# EasyEDA Pro project 3SE_24_Power_Rune.eprj, schematic Armour

## Sheets
1 十环灯: Create Date: 2023-11-28; Page Name: 十环灯; Project Name: 3SE_24_Power_Rune; Schematic Name: Armour; Update Date: 2023-12-28; Company: 东南大学3SE战队; Drawed: 程浩; Page Size: A4; Reviewed: 彭延璞，陈申; Version: V1.5
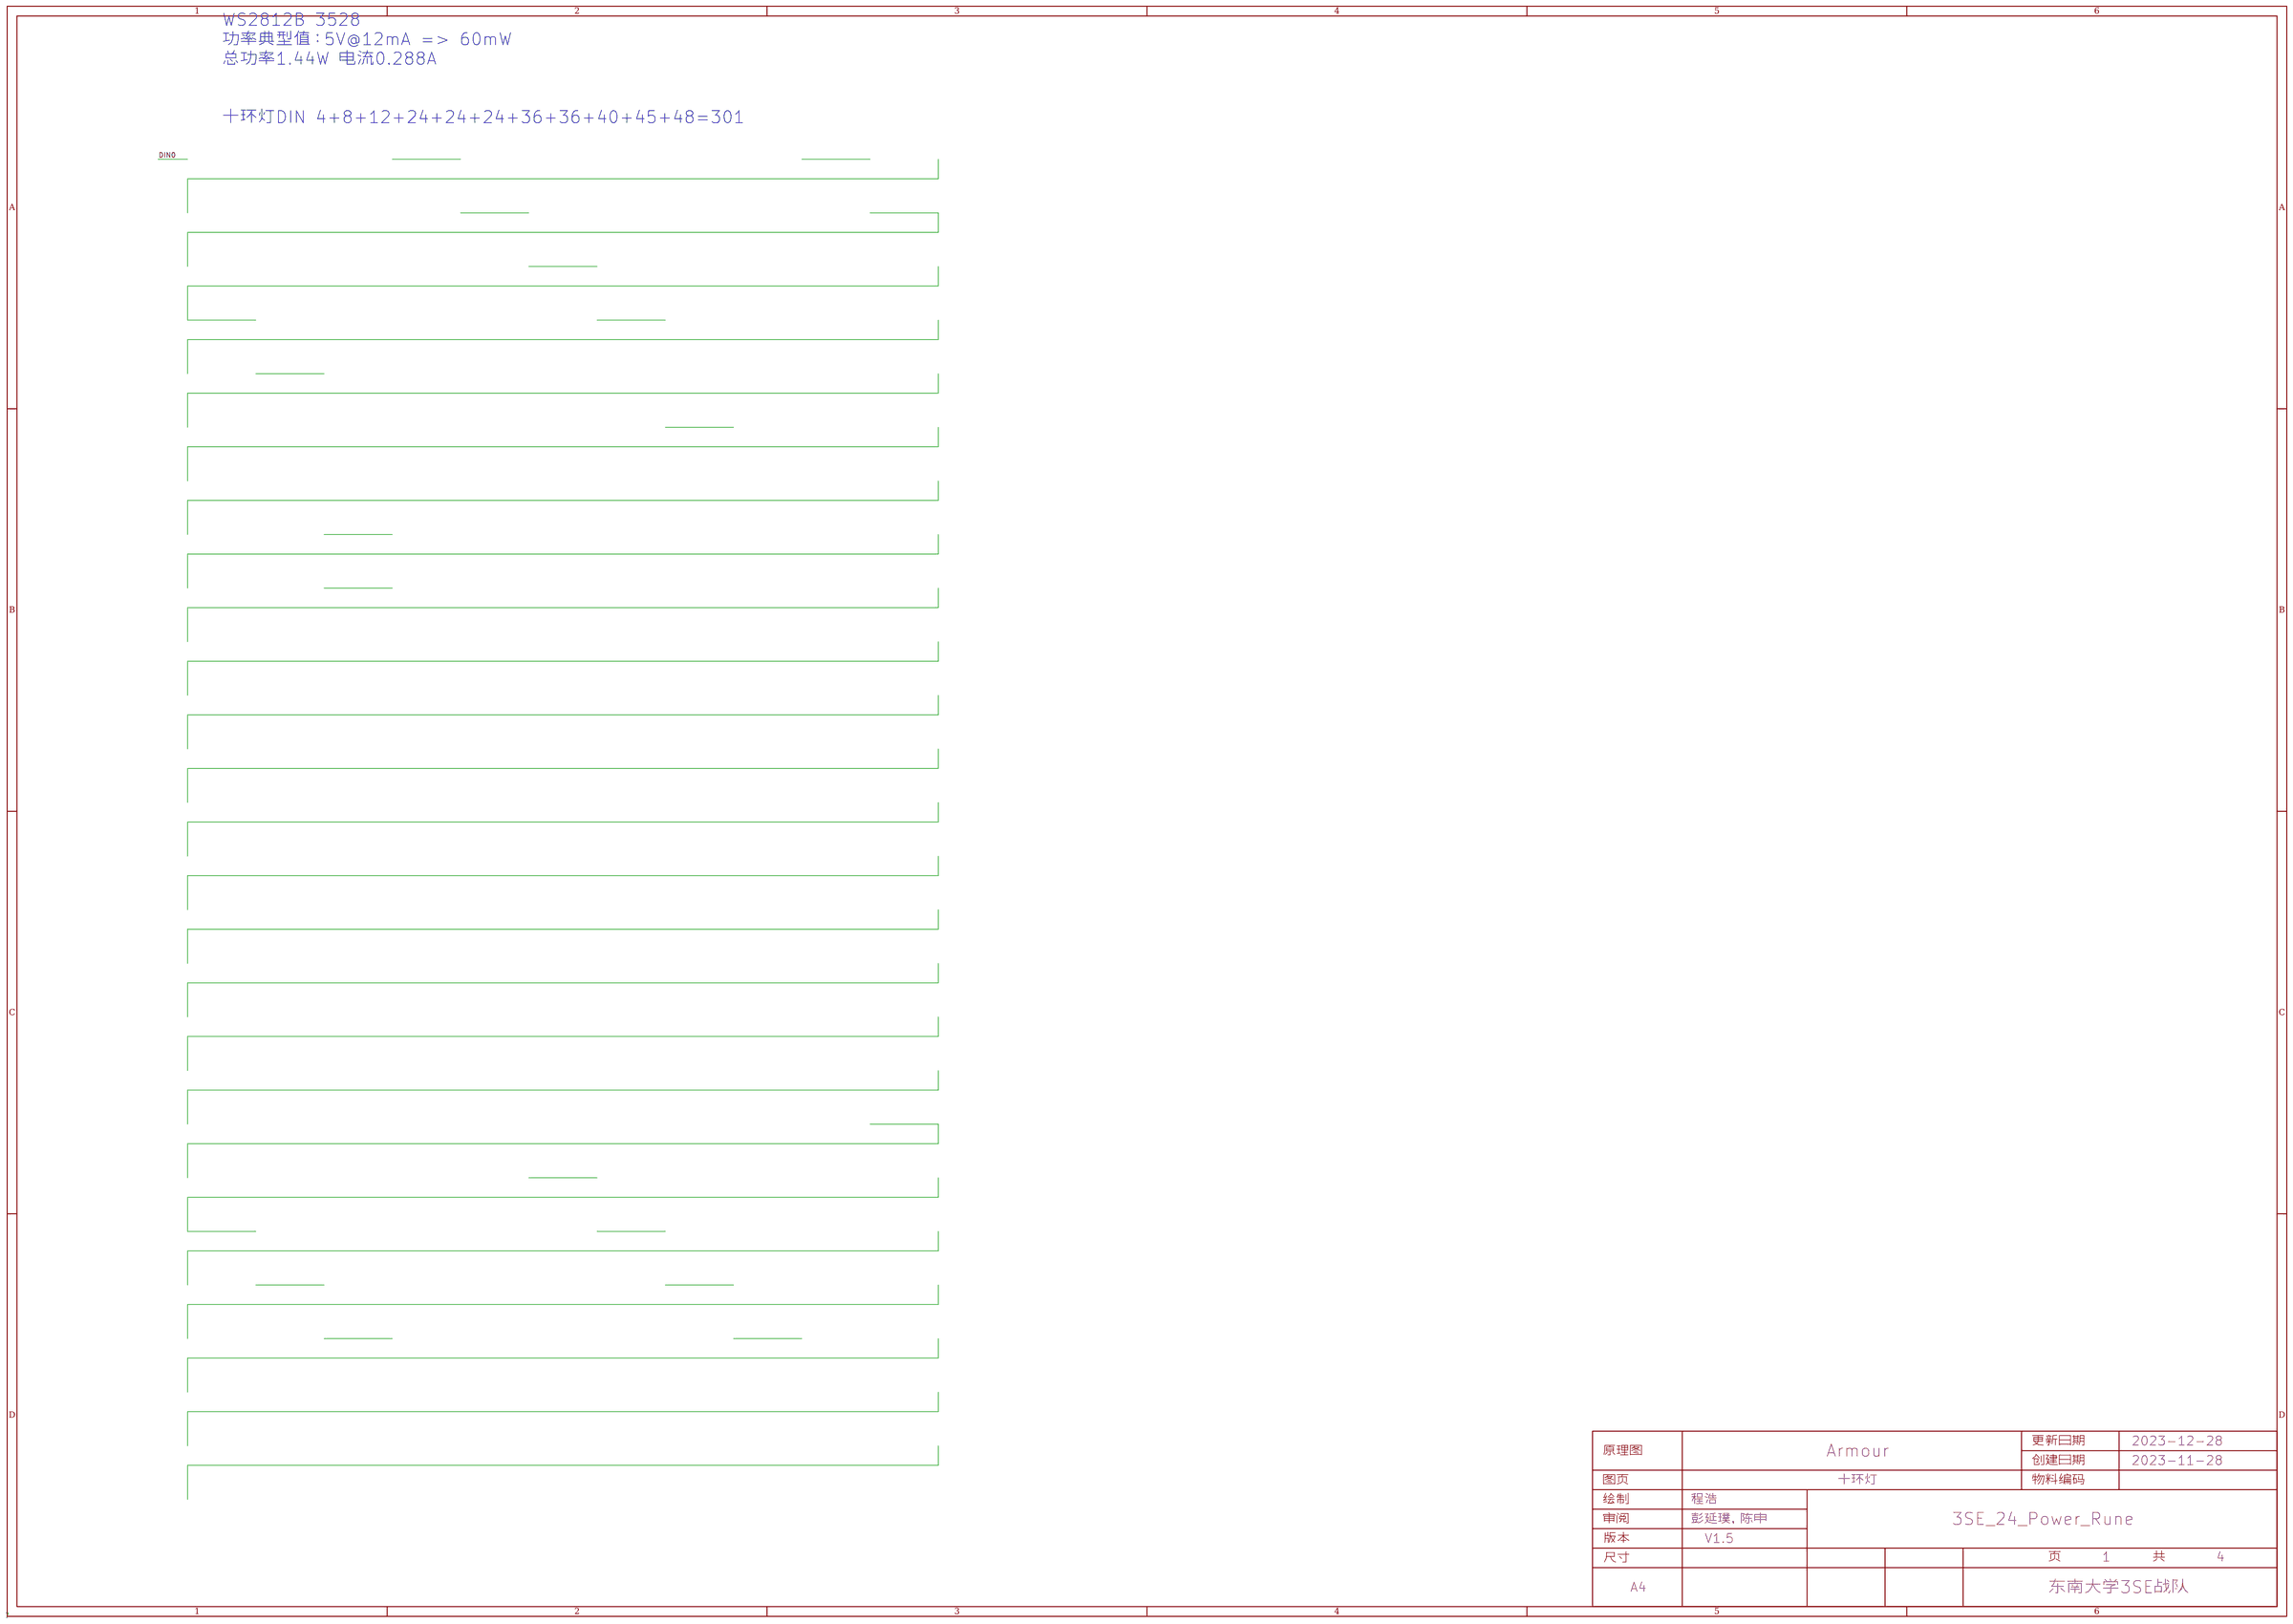
[diagram p2: 十环灯]
2 按键: Create Date: 2023-12-10; Page Name: 按键
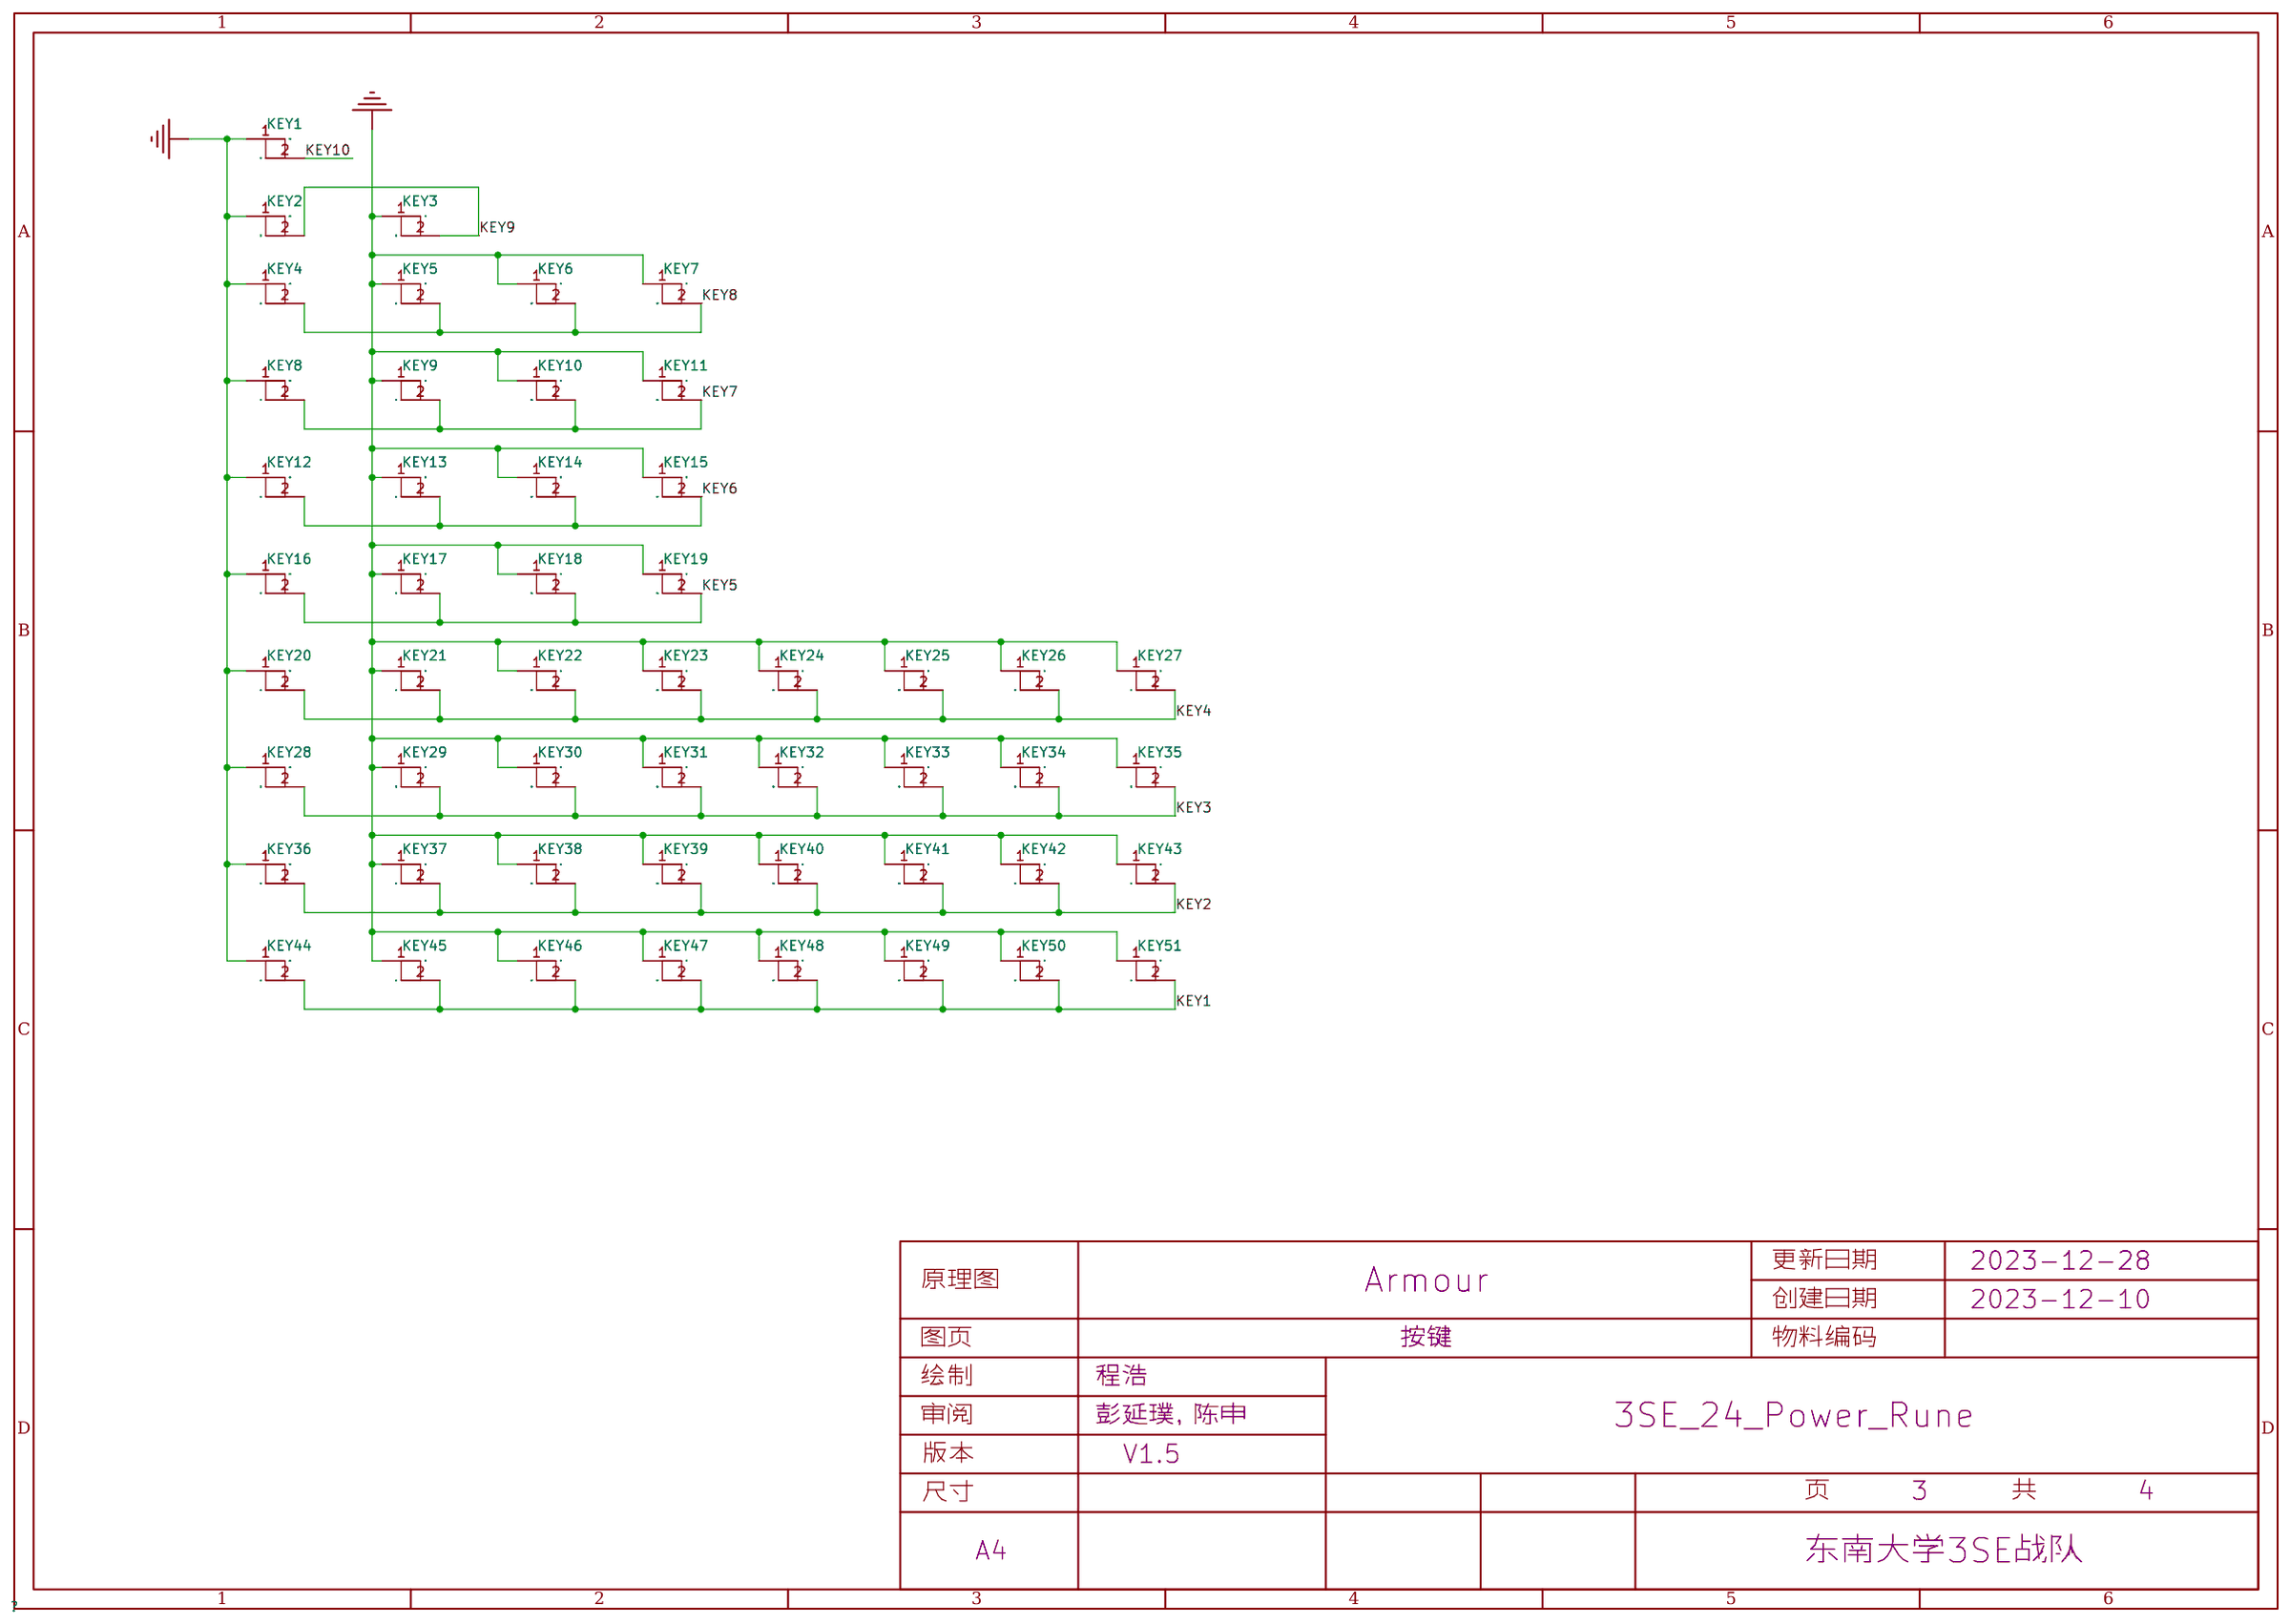
[diagram p3: 按键]
3 主控和电源: Create Date: 2023-12-10; Page Name: 主控和电源; Update Date: 2024-04-17
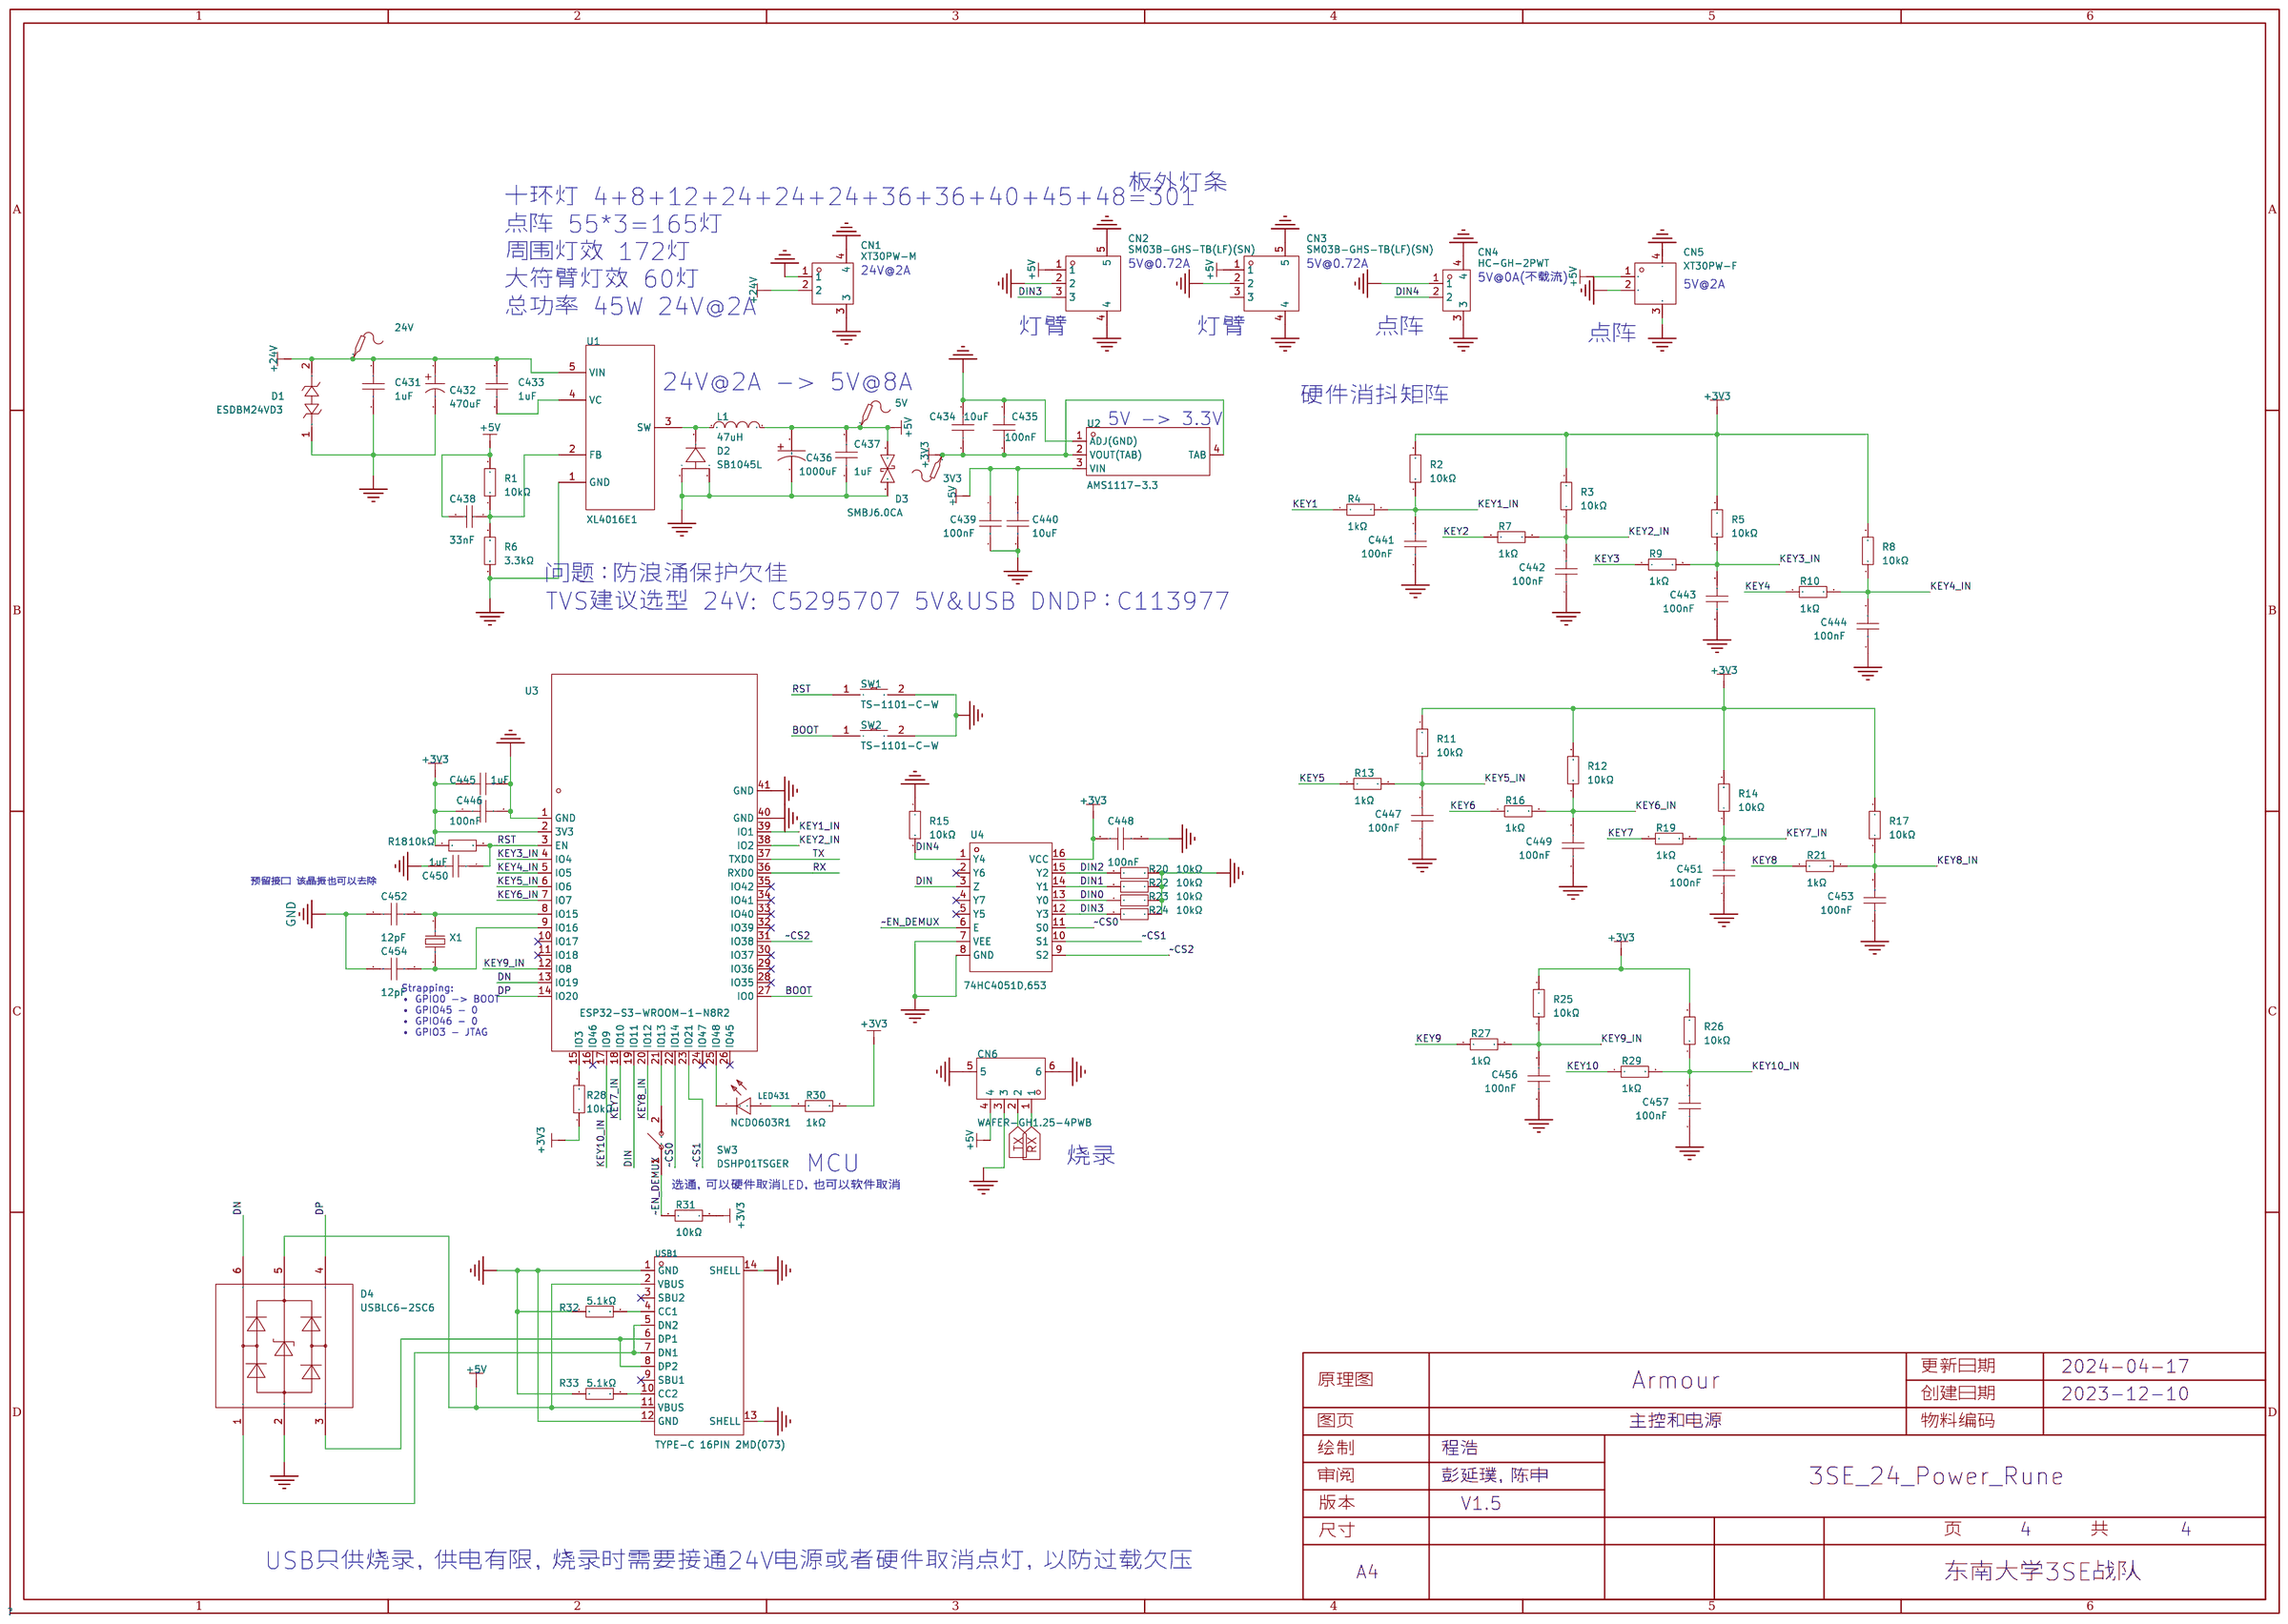
[diagram p4: 主控和电源]
4 四周灯: Create Date: 2023-12-10; Page Name: 四周灯